# EasyEDA Pro project PRO_project.eprj, board PCB1 (continued)
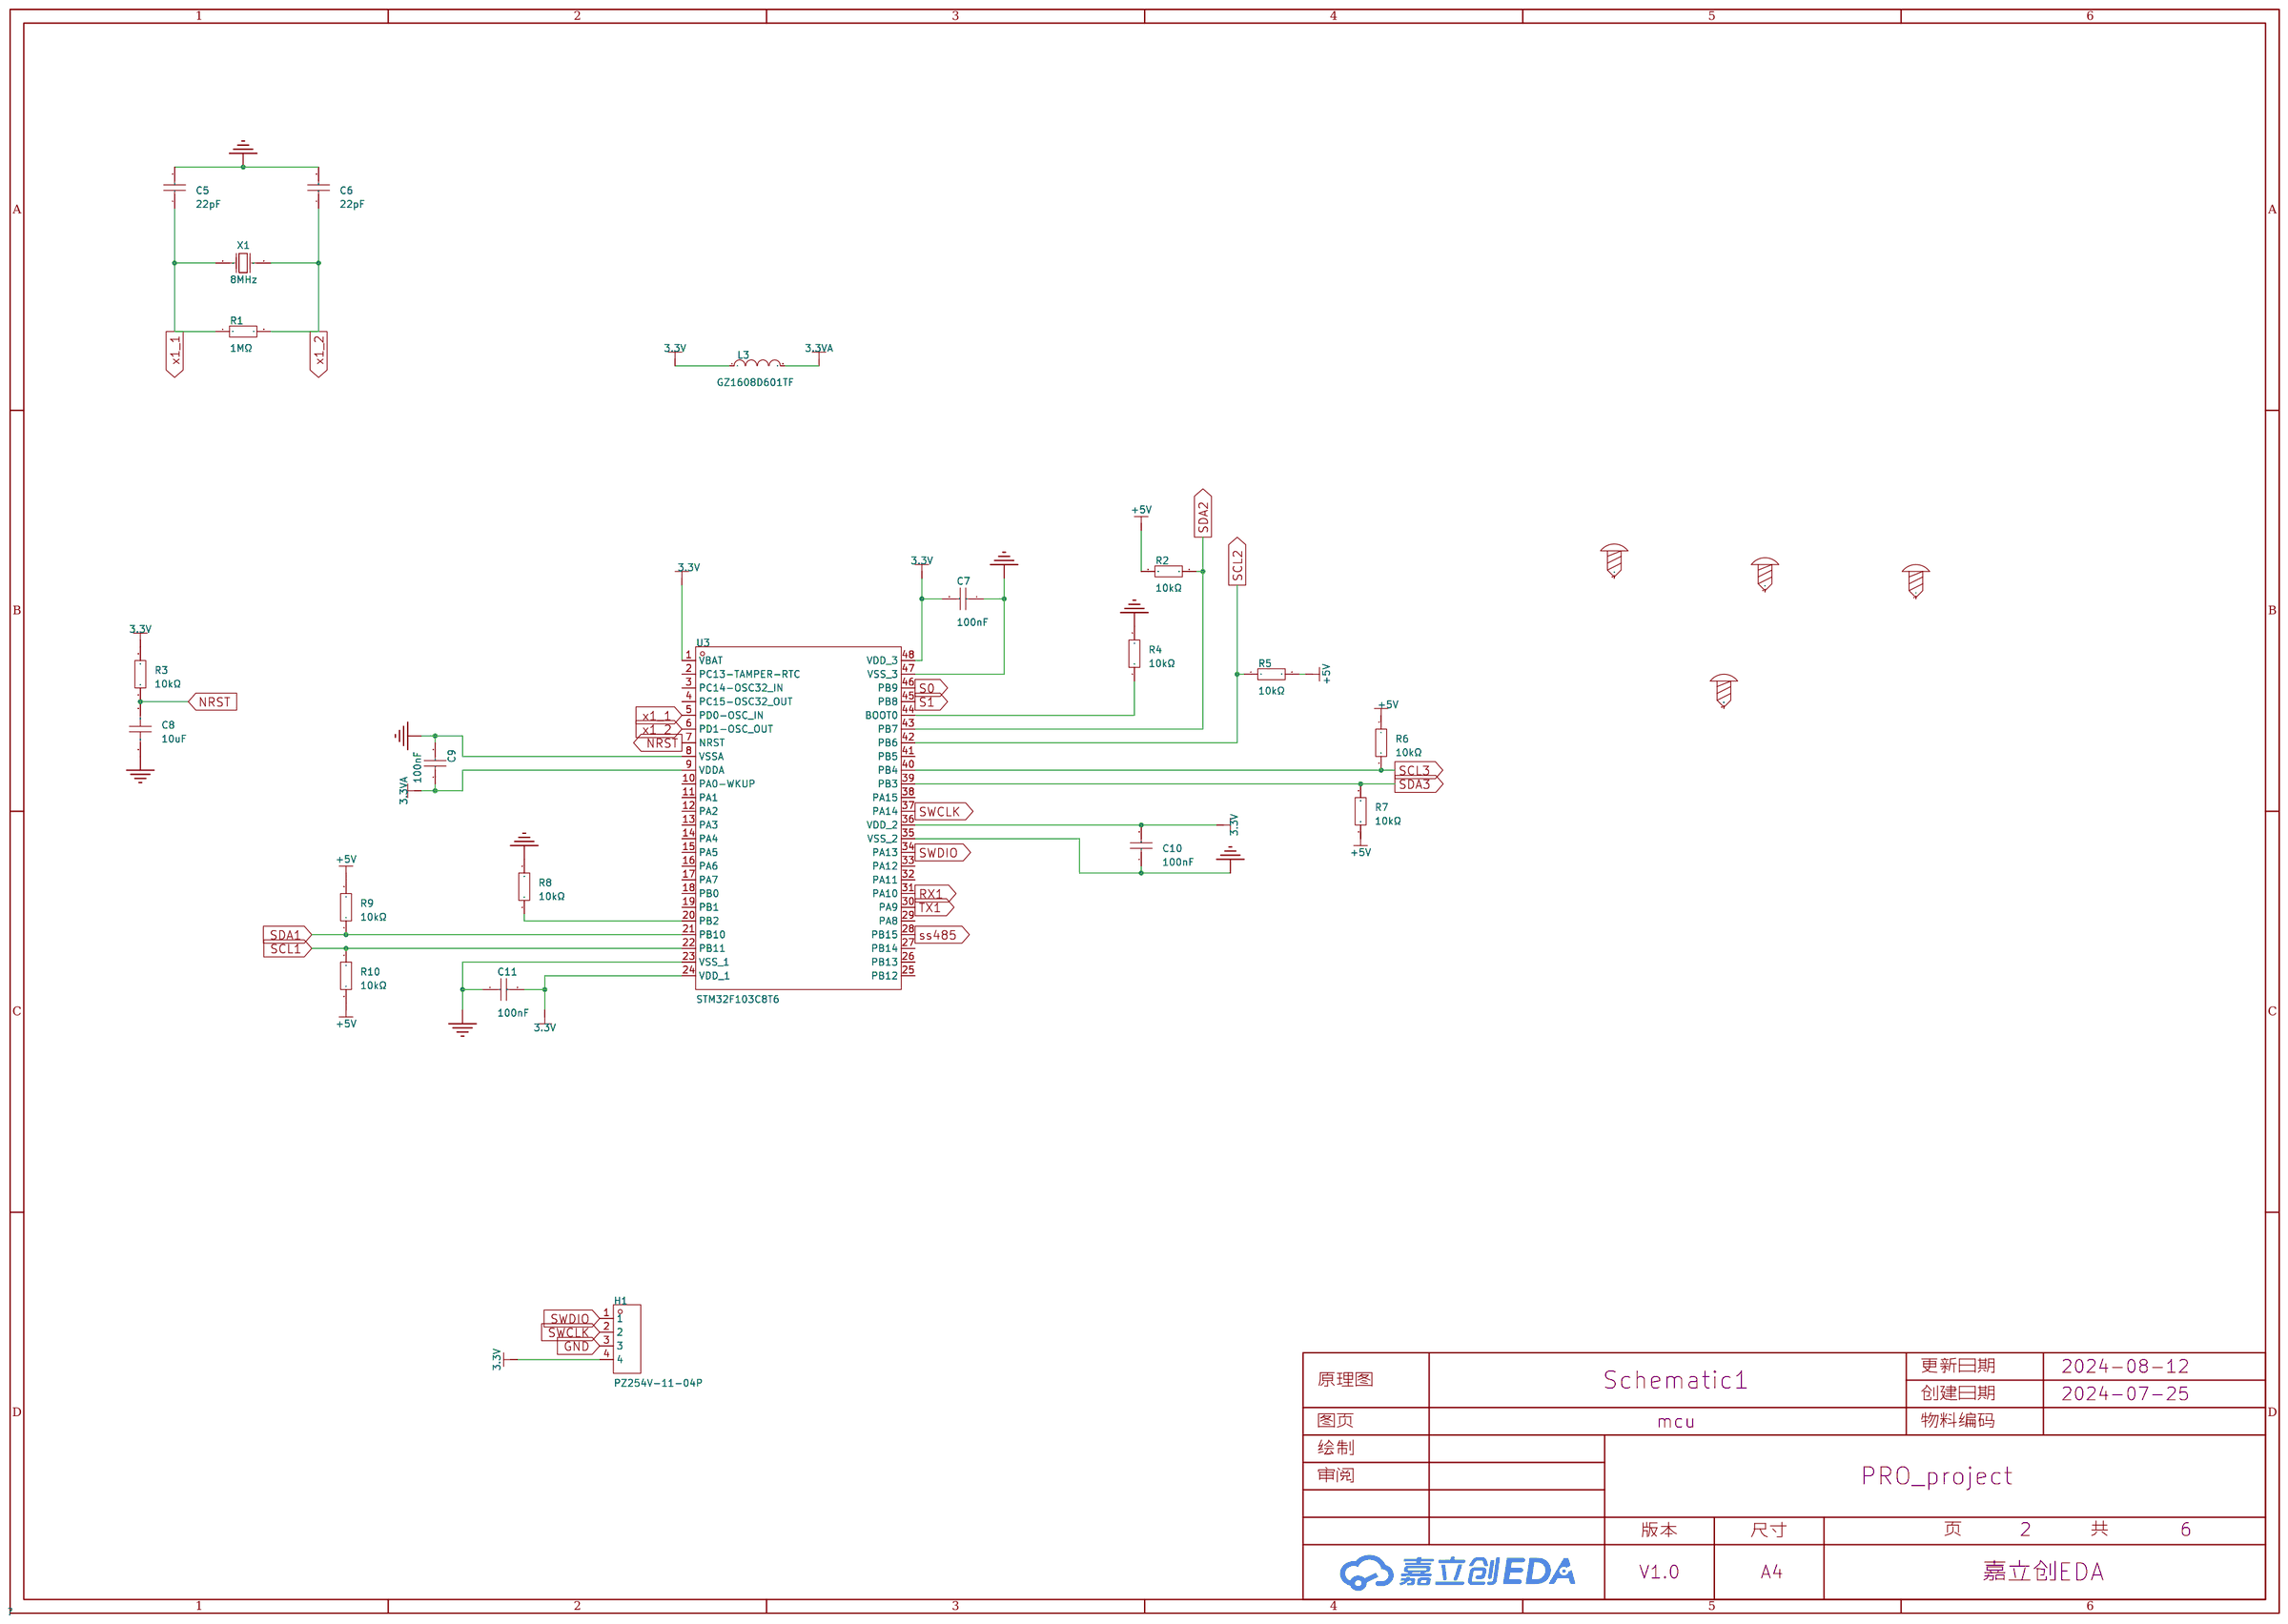
[diagram p0: mcu]
## Routing (per net, layer and track width the routed paths; a pad name or vN(x,y) marks a point on that pad's centre or on a via; arc(x,y) is an arc through that point) (continued)
  Top Layer w0.762: 29.47,27.43 34.4,27.43 U2.3 ; 29.47,27.43 L2.2 29.47,21.49 27.83,19.85 27.83,14.34 28.39,13.78 36.6,13.78 U36.2 ; 29.47,27.43 29.47,31.14 28.84,31.77 C3.1 27.2,33.87 25.42,35.65 15.18,35.65 U1.4 ; C20.2 3.9,52.94 v1(3.86,52.98) ; C49.1 34.82,46.91 v1(34.64,47.09)
  Bottom Layer w0.254: v1(36.18,35.29) 30.72,35.29 C3.1 ; v1(115.49,42.32) 115.52,42.32 ; v1(38.15,43.44) 34.64,46.95 34.64,46.99 v1(32.69,45.04) 32.69,45.14 ; v1(97.93,49.22) 97.93,50.07 97.9,50.1 ; v1(103.03,41.7) 103.03,50.25 102.99,50.29 ; v1(71.06,51.47) 71.04,51.49 69.59,51.49 69.06,50.96 69.06,50.03 v1(69.16,49.93) 69.1,49.93 ; v1(85.35,49.67) 85.97,50.29 89.95,50.29 ; 102.99,50.29 115.29,50.29 v1(115.49,50.09) ; 102.99,50.29 89.95,50.29 ; v1(12.9,53.61) 14.17,52.34 14.17,47.03 14.1,47.03 v1(14.05,47.08) ; 89.95,50.29 90.11,50.13 v1(90.11,49.02) ; v1(39.33,50.83) 38.38,50.83 v1(34.64,47.09)
  Bottom Layer w0.508: v1(115.49,42.32) 115.49,47.38 v1(115.47,47.4)
  Bottom Layer w0.762: U27.2 116.17,27.6 U24.2 102.64,27.26 U25.2 75.52,27.26 U26.2 67.84,27.78 67.63,27.99 ; 2.17,52.98 2.17,41.76 2.94,41 13.61,41 16.96,37.65 16.96,28.85 19.68,26.13 25.13,26.13 27.2,28.2 C3.1 ; 2.17,52.98 v1(3.86,52.98) ; 2.17,52.98 2.14,53.01 2.14,57.71 3.18,58.75 U8.2 U10.2 U9.2 U11.2 U16.2 U17.2 U18.2 U19.2 ; U36.2 34.36,14.29 33.35,13.27 33.35,10.48 34.22,9.61 64.06,9.61 67.63,13.18 67.63,27.99 ; 67.63,27.99 v1(67.63,29.17)
GND: length 502.2
  Top Layer w0.254: U20.5 102.53,33.75 C44.1 ; C4.2 42.49,26.54 v1(43.84,27.89) ; 98.95,40.06 98.97,40.07 101.12,40.07 ; v1(42.67,45.93) 44.44,47.7 ; v1(42.67,45.93) 39.98,45.93 v1(38.99,46.91) C49.2 ; v1(42.67,45.93) 42.76,45.84 42.76,44.02 43.81,42.97 C9.2 ; 44.44,47.7 C8.1 ; 44.44,47.7 43.75,47.7 42.92,48.53 v1(42.87,48.53) ; 45.47,37.12 45.47,37.71 v1(44.74,38.44) ; U13.5 65.5,56.54 C32.1 61.95,52.88 v1(61.95,50.6) ; H1.3 62.27,32.33 62.09,32.52 ; U21.5 87.71,33.08 C46.1 ; C53.2 116.06,39.74 v1(115.37,39.06) ; U29.2 32.69,39.67 30.33,37.31 v1(27.2,37.31) ; U6.5 20.29,53.75 C22.1 ; v1(66.41,49.42) 67.21,48.62 C51.2 ; U30.6 U30.7 U30.8 79.36,42.1 v1(79.99,41.47) 81.01,40.45 83.87,40.45 85.08,41.66 U31.2 ; C47.1 115.78,33.14 U23.5 ; v1(54.25,42.05) 54.69,42.05 55.59,42.95 55.59,43.97 56.18,44.56 v1(57.26,44.56) 58.24,45.54 v1(58.24,47.21) 58.24,50.99 57.52,51.71 49.07,51.71 48.74,51.38 v1(48.74,48.88) 47.92,48.06 v1(47.92,46.4) 47.92,45.72 49.27,44.37 51.08,44.37 v1(51.58,43.87) ; U3.23 53.57,34.27 53.57,34.28 v1(54.81,34.28) 54.81,33.38 54.82,33.38 U3.35 ; C35.1 105.79,54 U15.5 ; 22.18,42.71 24.28,42.71 U28.8 ; v1(27.2,37.31) 26.28,37.31 23.13,40.46 U28.7 ; v1(27.2,37.31) 27.13,37.24 ; U22.5 74.46,33.65 C45.1 ; C23.1 46.4,51.96 45.2,50.76 v1(43.56,50.76) ; C21.1 35.31,55.86 U5.5 ; v1(106.1,48.39) 106.1,48.38 106.1,46.46 ; C7.1 v1(59.84,40.59) 60.92,40.59 R4.2 ; v1(48.03,43.59) 48.03,43.42 48.38,43.07 50.54,43.07 51.82,41.79 U3.8 51.82,39.35 52.4,38.77 56.81,38.77 U3.47 ; v1(6.99,50.34) 2.23,50.34 2.21,50.36 ; U33.2 101.07,47.14 v1(101.08,47.15) ; C48.2 11.27,49.45 v1(11.27,50.34) ; U32.8 106.1,46.46 ; 106.1,46.46 U32.6 ; v1(86.79,48.74) 86.34,48.28 C50.2
  Top Layer w0.508: U4.5 7.87,56.21 U8.1 ; U15.5 106.46,56.21 U19.1 ; U5.5 35.16,56.21 U9.1 ; U6.5 21.23,56.21 U10.1 ; U25.1 89.52,30.06 C46.1 ; U16.1 64.95,56.21 U13.5 ; U11.1 49.47,56.21 U7.5 ; U18.1 91.96,56.21 U14.5 ; U26.1 74.92,30.4 C45.1 ; 76.68,56.21 79.04,56.21 U12.5 ; U24.1 102.72,30.4 C44.1 ; C47.1 116.62,33.12 U27.1
  Top Layer w0.762: U2.1 32.5,31.91 27.17,37.24 U1.5 v1(8.15,37.24) U1.6 ; D2.1 13.39,10.98 8.71,10.98 4.84,14.85 C1.2 4.84,33.75 U1.6 ; D2.1 13.7,11.19 CN1.2 ; D2.1 15.36,11.24 16.34,12.22 D3.1 ; U8.1 3.25,56.21 2.21,55.17 2.21,36.38 U1.6 ; C33.1 77.77,53.41 77.77,55.12 76.68,56.21 U17.1 ; 53.17,50.29 53.42,50.54 v1(53.42,51.77) ; 53.17,50.29 54.55,50.29 C5.2 ; 53.17,50.29 C6.2 ; U1.6 v1(8.5,33.84) U1.3 ; U18.1 91.31,55.27 91.31,53.8 C34.1
  Bottom Layer w0.254: v1(11.27,50.34) v1(6.99,50.34) ; v1(43.56,50.76) 42.92,50.12 42.92,48.6 42.87,48.55 v1(42.87,48.53) 43.48,48.53 48.03,43.98 v1(48.03,43.59) ; v1(66.41,49.42) 66.39,49.44 ; v1(115.37,39.06) 115.37,39.07
  Bottom Layer w0.762: v1(120.11,33.49) 120.11,33.18 U27.1 116.17,30.14 U24.1 102.64,29.8 U25.1 88.74,30.32 U26.1 ; U8.1 U10.1 U9.1 U11.1 U16.1 ; U19.1 U18.1 U17.1 U16.1 ; U16.1 62.61,51.26 v1(61.95,50.6)
  vias: v1(1.18,29.01) v1(1.53,38.14) v1(7.95,29.01) v1(10.46,51.99) v1(32.44,49) v1(40.12,40.39) v1(42.95,30.48) v1(48.73,29.82) v1(50.45,25) v1(51.51,22.39) v1(56.75,11) v1(59.14,14.11) v1(59.34,18.6) v1(60.96,10.8) v1(65.12,12.38) v1(78.68,33.93) v1(90.15,37.54) v1(98.96,40.08) v1(111.18,43.17) v1(113.64,52.24) v1(116.98,45.17) v1(117.06,47.2) v1(117.06,36) v1(118.09,52.24) v1(120.16,36.64) v1(120.56,44.5)
1N0: length 35.3
  Top Layer w0.254: v1(36.56,53.86) 36.63,53.86 36.78,54 36.78,55.86 ; v1(15.4,44.47) 15.51,44.36 15.51,42.59
  Bottom Layer w0.254: v1(15.4,44.47) 15.35,44.47 15.35,53.93 15.92,54.5 35.92,54.5 v1(36.56,53.86)
1N1: length 25.5
  Top Layer w0.254: 20.59,42.59 20.62,42.56 20.62,39.98 v1(20.64,39.98) ; v1(23.35,53.51) 23.35,55.35 U6.6
  Bottom Layer w0.254: v1(20.64,39.98) 19.98,39.32 18.91,39.32 17.82,40.41 17.82,51.37 19.47,53.02 22.86,53.02 v1(23.35,53.51)
1N2: length 18.3
  Top Layer w0.254: 9.2,56.15 9.2,49.75 13.31,45.64 15.98,45.64 16.78,44.84 U28.2
1N3: length 46.6
  Top Layer w0.254: U28.4 19.32,40.59 v1(19.29,40.57) ; v1(49.15,53.56) 50.96,55.36 U7.6
  Bottom Layer w0.254: v1(19.29,40.57) 19.29,51 19.98,51.69 47.28,51.69 v1(49.15,53.56)
1P0: length 23.6
  Top Layer w0.254: 20.59,48.06 20.59,49.98 21.6,51 36.22,51 38.07,52.85 38.07,55.83 U5.7
1P1: length 13.1
  Top Layer w0.254: U28.14 18.05,50.45 19.34,51.75 24.35,51.75 24.6,52 24.6,55.37 U6.7
1P2: length 11.8
  Top Layer w0.254: U28.15 16.78,49.59 16.24,50.13 14.31,50.13 10.47,53.97 U4.7
1P3: length 34.7
  Top Layer w0.254: U28.11 21.86,49.56 22.18,49.89 46.48,49.89 52.23,55.63 U7.7
1ZN: length 17.5
  Top Layer w0.254: U28.3 18.05,44 18.36,44.32 28.98,44.32 29.73,43.57 29.73,42.07 30.81,40.99 U29.1
1ZP: length 16
  Top Layer w0.254: U28.13 19.32,46.04 19.97,45.39 31,45.39 31.74,44.65 U29.6
2N0: length 40
  Top Layer w0.254: v1(67.9,43.03) 68.83,42.1 U30.1 ; U14.6 94.67,54.76 94.67,52.98 94.19,52.5 v1(93.54,52.5)
  Bottom Layer w0.254: v1(93.54,52.5) 68.7,52.5 67.9,51.7 v1(67.9,43.03)
2N1: length 43.5
  Top Layer w0.254: U12.6 80.77,54.16 v1(80.64,54.04) ; U30.5 74.59,39.49 v1(74.62,39.46)
  Bottom Layer w0.254: v1(80.64,54.04) 65.14,54.04 64.02,52.92 64.02,43.61 68.57,39.06 74.22,39.06 v1(74.62,39.46)
2N2: length 19.6
  Top Layer w0.254: U30.2 70.7,42.18 70.7,44.29 69.44,45.55 66.15,45.55 65.1,46.6 65.1,50.78 66.77,52.44 U13.6
2N3: length 50.2
  Top Layer w0.254: v1(108.43,53.01) 108.38,53.06 108.38,55.32 U15.6 ; v1(73.27,40.29) 73.32,40.33 U30.4
  Bottom Layer w0.254: v1(73.27,40.29) 73.27,49.66 75.29,51.67 107.1,51.67 v1(108.43,53.01)
2P0: length 27.4
  Top Layer w0.254: U14.7 95.67,54.88 95.67,51.53 95.1,50.96 75.9,50.96 74.59,49.64 U30.12
2P1: length 16.5
  Top Layer w0.254: 82.04,55.75 82.04,53.36 80.31,51.64 73.21,51.64 72.05,50.47 U30.14
2P2: length 10.3
  Top Layer w0.254: 68.04,56.75 68.04,52.92 70.78,50.18 U30.15
2P3: length 40.8
  Top Layer w0.254: U30.11 75.86,49.48 76.73,50.36 109.04,50.36 109.74,51.06 109.74,55.41 U15.7
2ZN: length 14.4
  Top Layer w0.254: U31.1 84.09,42.58 84.09,43.21 83.54,43.76 72.49,43.76 72.05,43.31 U30.3
2ZP: length 13.1
  Top Layer w0.254: U31.6 83.55,44.66 74.81,44.66 73.32,46.15 U30.13
3N0: length 42.4
  Top Layer w0.254: U32.1 113.72,45.2 v1(114.2,44.72) ; v1(86.06,33.8) 85.42,33.8 84.73,33.1 U21.6
  Bottom Layer w0.254: v1(114.2,44.72) 114.2,37.16 111.18,34.14 87.21,34.14 86.87,33.8 v1(86.06,33.8)
3N1: length 26.9
  Top Layer w0.254: v1(108.62,48.64) 108.64,48.62 U32.5 ; v1(99.8,35.33) 99.8,34.44 98.72,33.36 98.75,33.36 98.75,31.27 U20.6
  Bottom Layer w0.254: v1(99.8,35.33) 100.99,36.52 106.54,36.52 108.59,38.57 108.59,48.61 v1(108.62,48.64)
3N2: length 21.7
  Top Layer w0.254: U32.2 112.45,44.11 112.7,43.86 116.67,43.86 117.3,43.23 117.3,38.65 112.44,33.78 U23.6
3N3: length 74
  Top Layer w0.254: v1(109.88,48.84) 109.91,48.81 U32.4 ; v1(70.89,32.72) 70.89,31.35 U22.6
  Bottom Layer w0.254: v1(70.89,32.72) 115.14,32.72 118.49,36.07 118.49,48.04 117.29,49.24 110.28,49.24 v1(109.88,48.84)
3P0: length 32.3
  Top Layer w0.254: U21.7 83.46,34.05 84.08,34.67 93.73,34.67 95.65,36.59 106.85,36.59 108.64,38.37 U32.12
3P1: length 21.9
  Top Layer w0.254: U32.14 111.18,37.95 109.14,35.91 98.01,35.91 97.5,35.4 U20.7
3P2: length 10.5
  Top Layer w0.254: U23.7 111.17,35.23 112.54,36.61 112.54,40.9 U32.15
3P3: length 45
  Top Layer w0.254: U22.7 69.58,34.05 70.76,35.24 93.23,35.24 95.33,37.34 106.36,37.34 107.37,38.34 U32.11
3ZN: length 11.4
  Top Layer w0.254: U32.3 111.18,44.75 110.95,44.53 103.07,44.53 U33.1
3ZP: length 9.7
  Top Layer w0.254: U33.6 109.63,42.88 109.97,42.54 109.97,41.06 U32.13
485+: length 46.9
  Top Layer w0.254: v1(50.14,18.13) 54.03,18.13 U37.4
  Top Layer w0.381: v1(40.4,12.8) 39.53,13.67 R61.1 39.53,15.57 41.02,17.05 42.2,17.05
  Top Layer w0.762: C55.2 30.74,19.12 31.4,19.78 35.45,19.78 ; 35.45,19.78 35.45,23.08 R67.2 35.44,23.12 R63.2 ; 35.45,19.78 36.7,19.78 U36.4
  Bottom Layer w0.254: v1(50.14,18.13) 49.34,17.33 49.34,13.84 48.3,12.8 v1(40.4,12.8)
  Bottom Layer w0.381: v1(40.4,12.8) 41.49,13.89 41.49,17.05 38.8,19.74 37.48,19.74 U36.4
485-: length 51.1
  Top Layer w0.381: U35.3 45.21,27.51 v1(44.36,26.66) ; v1(50.58,12.58) 50.58,14.27 50.43,14.42 ; U36.3 39.21,16.83 39.58,17.2 39.58,20.22 40.29,20.93 42.13,20.93 42.2,20.86 44.24,20.86 v1(44.32,20.95) 44.29,20.98 44.29,22.8 R65.1
  Top Layer w0.762: U36.3 36.49,16.21 31.66,16.21 30.74,17.13 C55.1
  Bottom Layer w0.381: v1(50.58,12.58) 50.56,12.56 50.56,11.95 49.82,11.21 39.59,11.21 39.28,11.52 39.28,16.37 38.82,16.83 U36.3 ; v1(44.36,26.66) 44.36,20.99 v1(44.32,20.95)
DI: length 15.1
  Top Layer w0.381: U34.4 47.79,21.05 U35.4
  Top Layer w0.762: U35.4 47.66,24.84 R63.1
NRST: length 10.6
  Top Layer w0.254: U3.7 52.32,42 50.75,43.57 49.31,43.57 46.83,46.05 R3.1 46.68,46.32 C8.2
RO: length 9.9
  Top Layer w0.254: U34.1 50.63,17.05 52.07,15.61 52.07,13.08 52.48,12.67 U38.2
RX1: length 34.3
  Top Layer w0.254: 65.45,25.9 65.74,25.61 65.74,15.74 65.05,15.05 63.25,15.05 U38.4 ; 65.45,25.9 v1(65.35,25.9) ; 65.45,25.9 64.74,26.61 R66.2 ; v1(53.81,29.17) 52.82,30.16 U3.31
  Bottom Layer w0.254: v1(65.35,25.9) 64.38,24.93 54.82,24.93 53.81,25.94 v1(53.81,29.17)
S0: length 110.1
  Top Layer w0.254: v1(77.1,45.82) 77.1,47.55 U30.10 ; U28.10 23.13,46.72 23.61,46.24 33.99,46.24 34.7,45.53 39.12,45.53 43.6,41.05 v1(46.46,41.05) ; v1(91.75,38.74) 91.75,38.7 92.32,38.13 105.39,38.13 106.1,38.83 106.1,40.99 ; v1(50.98,38.59) 51.3,38.27 U3.46 57.86,38.27 v1(58.58,38.99)
  Bottom Layer w0.254: v1(91.75,38.74) 91.73,38.76 91.73,45.97 90.32,47.38 78.66,47.38 v1(77.1,45.82) 77.1,38.07 76.04,37.01 67.82,37.01 65.84,38.99 v1(58.58,38.99) ; v1(50.98,38.59) 48.52,41.05 v1(46.46,41.05)
S1: length 101.2
  Top Layer w0.254: v1(40.46,47.33) 39.73,48.06 U28.9 ; v1(78.46,45.64) 78.4,45.7 U30.9 ; v1(59.12,38.15) 58.74,37.77 U3.45 v1(50.39,37.77) ; U32.9 104.83,39.64 104.57,39.39 95.58,39.39 v1(95.45,39.26)
  Bottom Layer w0.254: v1(78.46,45.64) 78.46,38.4 76.57,36.51 ; 76.57,36.51 92.7,36.51 v1(95.45,39.26) ; 76.57,36.51 67.47,36.51 65.83,38.15 v1(59.12,38.15) ; v1(50.39,37.77) 48.11,37.77 45.05,40.83 45.05,41.87 40.46,46.46 v1(40.46,47.33)
SCL1: length 18.7
  Top Layer w0.254: U3.22 42.87,34.77 40.11,37.53 38.96,37.53 38.94,37.51 38.9,37.47 34.78,37.47 33.64,38.61 U29.3
SCL2: length 39.8
  Top Layer w0.254: R5.1 88.54,42.63 v1(88.54,41.23) 88.54,40.49 87.14,39.09 78.4,39.09 77.13,37.82 64.66,37.82 63.11,36.27 U3.42 ; U31.3 86.07,42.5 86.02,42.45 v1(86.02,41.05)
  Bottom Layer w0.254: v1(86.02,41.05) 88.36,41.05 v1(88.54,41.23)
SCL3: length 47.7
  Top Layer w0.254: U33.3 99.94,45.76 R6.2 95.19,45.76 87.83,38.4 80.29,38.4 79.04,37.15 68.01,37.15 66.13,35.27 U3.40
SDA1: length 21.7
  Top Layer w0.254: U29.4 35.37,43.69 35.67,43.39 35.67,39.94 36.38,39.23 38.74,39.23 R9.1 41.57,39.36 42.43,38.5 42.43,36.14 43.3,35.27 U3.21
SDA2: length 39.5
  Top Layer w0.254: U31.4 87.38,45.24 ; 87.38,45.24 88.52,45.24 R2.2 ; 87.38,45.24 87.44,45.18 87.44,40.69 86.42,39.67 78.03,39.67 76.69,38.33 64.42,38.33 62.86,36.77 U3.43
SDA3: length 46.7
  Top Layer w0.254: U3.39 66.87,34.77 68.74,36.64 79.9,36.64 81.08,37.82 88.54,37.82 93.61,42.89 100.11,42.89 U33.4
SS: length 13
  Top Layer w0.381: U34.3 U34.2 ; U34.3 47.55,19.54 46.37,19.54 45.96,19.95 R65.2 ; U34.3 50.26,19.59 51.28,20.62 54.08,20.62 U37.3
SS485: length 20.2
  Top Layer w0.254: U37.2 59.4,20.61 57.25,22.76 54.46,22.76 51.32,25.9 U3.28
SWCLK: length 5.6
  Top Layer w0.254: H1.2 59.75,30.36 59.75,32.51 58.49,33.77 U3.37
SWDIO: length 4.6
  Top Layer w0.254: U3.34 54.32,30.77 54.84,30.25 57.01,30.25 57.14,30.12
TX1: length 8.5
  Top Layer w0.254: U35.2 56.61,27.43 53.59,27.43 52.32,28.7 U3.30
X1_1: length 10.9
  Top Layer w0.254: 56.51,50.39 56.51,47.44 X1.2 54.39,45.32 R1.1 53.32,42.16 U3.5
X1_2: length 10.5
  Top Layer w0.254: 49.9,50.04 49.9,47.13 X1.1 52.89,44.15 R1.2 52.82,43.17 U3.6
$1N1353: length 7.9
  Top Layer w0.254: U3.44 61.06,37.27 61.79,38 R4.1
$1N9152: length 3.3
  Top Layer w0.254: R8.2 45.47,35.85 45.55,35.77 U3.20
$2N657: length 14.3
  Top Layer w0.762: U1.2 17.54,32.14 19.14,30.54 19.14,26.83 19.09,26.78 19.21,26.66 ; D3.2 16.81,26.66 19.21,26.66 ; 19.21,26.66 L1.2
$2N1653: length 14.3
  Top Layer w0.762: C2.1 24.24,15.5 22.25,15.5 21.75,16 L1.1 25.86,20.06 26.87,21.07 L2.1
$2N2288: length 10.9
  Top Layer w0.762: D1.2 18.91,11.31 D2.2 18.83,4.19 CN1.1
$2N2289: length 21.7
  Top Layer w0.762: U1.1 12.97,30.44 12.47,29.94 12.47,20.41 11.7,19.64 C1.1 9.84,18.77 D1.1
$3N444: length 5.4
  Top Layer w0.762: R22.1 40.15,71.19 R21.1
$3N877: length 14.7
  Top Layer w0.254: U9.3 32.79,61.3 31.26,61.3 30.76,61.8 30.76,68.08 31.02,68.34 C17.1 35.06,68.34 35.45,67.95 35.45,66.81 U5.4
$3N883: length 11.9
  Top Layer w0.254: U5.1 39.32,65.39 39.04,65.12 34.09,65.12 U9.4 32.18,64.45 C17.2
$3N1473: length 7
  Top Layer w0.762: R15.2 22.95,81.72 CN4.1
$3N1476: length 6.7
  Top Layer w0.762: CN4.2 28.35,82.12 R16.2
$3N1479: length 5.5
  Top Layer w0.762: R23.1 28.15,71.03 R24.1
$3N1489: length 16.8
  Top Layer w0.254: R15.1 20.49,74.73 20.05,74.29 20.05,70.75 21.63,69.17 22.64,69.17 23.26,68.55 U6.3
  Top Layer w0.762: R15.1 22.95,74.07 ; 22.95,74.07 R23.2 ; 22.95,74.07 23,74.03 C14.1
$3N1497: length 17.9
  Top Layer w0.254: U6.2 24.53,68.63 24.74,68.85 29.05,68.85 30.27,70.07 30.27,73.58 29.82,74.03 28.35,74.03
  Top Layer w0.762: 28.35,74.07 R24.2 ; 28.35,74.07 28.31,74.03 C14.2 ; 28.35,74.07 R16.1
$3N1505: length 15.7
  Top Layer w0.254: U6.4 22.02,66.38 22.02,67.26 20.91,68.37 C18.1 16.72,68.37 16.2,67.85 16.2,63.26 18.05,61.41 18.98,61.41 U10.3
$3N1512: length 12.5
  Top Layer w0.254: U6.1 25.8,65.31 25.23,64.75 21.01,64.75 20.09,63.83 U10.4 18.4,63.83 17.78,64.45 17.78,66.83 C18.2
$3N1940: length 8.9
  Top Layer w0.762: CN2.1 7.76,77 R11.2
$3N1943: length 8.7
  Top Layer w0.762: CN2.2 18.83,82.24 R12.2
$3N1946: length 5.6
  Top Layer w0.762: R19.1 R20.1
$3N1956: length 14.7
  Top Layer w0.254: 7.76,73.77 6.64,73.77 5.76,72.89 5.76,69.72 6.53,68.95 8.6,68.95 9.2,68.35 9.2,67.05
  Top Layer w0.762: 7.76,73.77 R19.2 ; 7.76,73.77 9.76,73.77 C12.1 ; 7.76,73.77 R11.1
$3N1964: length 15.3
  Top Layer w0.254: U4.2 10.47,68.01 11.44,68.99 14.36,68.99 14.96,69.59 14.96,73.06 14.81,73.21 13.82,73.21 13.36,73.67
  Top Layer w0.762: 13.36,73.67 13.36,74.57 R12.1 ; 13.36,73.67 R20.2 ; 13.36,73.67 13.36,73.67 C12.2
$3N1972: length 13.8
  Top Layer w0.254: U8.3 2.4,64.35 2.4,67.54 3.1,68.24 C16.1 5.54,68.24 6.5,67.28 7.7,67.28 U4.4
$3N1979: length 12.5
  Top Layer w0.254: C16.2 4.11,65.18 U8.4 5.46,64.67 6.21,65.42 11.51,65.42 11.74,65.64 U4.1
$3N2407: length 8.5
  Top Layer w0.762: CN5.1 45.56,78.92 47.24,77.24 48.6,77.24 R17.2
$3N2410: length 8.1
  Top Layer w0.762: R18.2 54.55,79.3 CN5.2
$3N2413: length 5.7
  Top Layer w0.762: R25.1 R26.1
$3N2423: length 14.9
  Top Layer w0.254: U7.3 50.96,68.17 49.81,69.32 47.67,69.32 47,69.99 47,73 47.19,73.19 R25.2
  Top Layer w0.762: 48.85,74.01 R25.2 ; 48.85,74.01 50.73,74.01 C15.1 ; 48.85,74.01 R17.1
$3N2431: length 16
  Top Layer w0.254: U7.2 52.23,68.56 52.55,68.89 55.86,68.89 56.26,69.29 56.26,73.31 55.63,73.94 54.55,73.94
  Top Layer w0.762: 54.55,73.94 54.4,73.79 C15.2 ; 54.55,73.94 R18.1 ; 54.55,73.94 R26.2
$3N11930: length 7.2
  Top Layer w0.762: R33.2 105.34,81.02 CN6.1
$3N11931: length 5.3
  Top Layer w0.762: R39.1 96.54,71.04 R40.1
$3N11934: length 17.4
  Top Layer w0.254: U14.3 94.48,68.27 92.99,69.76 90.16,69.76 89.05,70.87 89.05,72.7 89.92,73.57 90.81,73.57 R39.2
  Top Layer w0.762: 91.34,73.96 91.34,74.74 R31.1 ; 91.34,73.96 R39.2 ; 91.34,73.96 93.12,73.96 C26.1
$3N11935: length 17.6
  Top Layer w0.254: R32.1 97.11,74.47 98.58,74.47 99.41,73.64 99.41,70.46 98.34,69.39 96.49,69.39 95.75,68.64 U14.2
  Top Layer w0.762: C26.2 96.46,73.84 96.64,74.02 ; 96.64,74.02 R40.2 ; 96.64,74.02 R32.1
$3N11945: length 12.1
  Top Layer w0.762: CN9.1 66.66,83.11 64.47,80.92 64.47,77.17 R29.2
$3N11946: length 5.3
  Top Layer w0.762: R36.1 82.94,71.24 R35.1
$3N11949: length 17.6
  Top Layer w0.254: R35.2 77.41,73.77 75.61,73.77 75.35,73.51 75.35,70.53 75.99,69.89 79.12,69.89 80.77,68.24 U12.3
  Top Layer w0.762: 77.94,73.93 R35.2 ; 77.94,73.93 R27.1 ; 77.94,73.93 79.75,73.93 C24.1
$3N11950: length 14.8
  Top Layer w0.254: 83.14,73.84 84.27,73.84 85.34,72.77 85.34,69.89 84.51,69.06 82.84,69.06 82.04,68.25 82.04,66.65
  Top Layer w0.762: 83.14,73.9 R36.2 ; 83.14,73.9 R28.1 ; 83.14,73.9 83.08,73.84 C24.2
$3N11960: length 8.3
  Top Layer w0.762: R27.2 78.78,77.04 82.21,80.47 CN7.1
$3N11961: length 5.4
  Top Layer w0.762: R38.1 69.74,71.14 R37.1
$3N11964: length 15.7
  Top Layer w0.254: U13.3 66.77,68.91 66.2,69.48 63.33,69.48 62.02,70.79 62.02,72.83 63.26,74.06 64.44,74.06
  Top Layer w0.762: R29.1 64.44,74.94 64.44,74.06 ; C25.1 64.77,73.74 64.44,74.06 ; 64.44,74.06 R37.2
$3N11965: length 15.9
  Top Layer w0.254: 68.04,67.65 68.04,69.21 68.47,69.65 71.52,69.65 72.18,70.31 72.18,73.36 71.48,74.06 69.84,74.06
  Top Layer w0.762: R30.1 R38.2 69.34,73.74 C25.2
$3N11974: length 5.8
  Top Layer w0.762: R41.1 111.05,71.14 R42.1
$3N11977: length 17.2
  Top Layer w0.254: 105.34,73.94 103.63,73.94 103.16,73.47 103.16,70.24 103.65,69.75 106.54,69.75 108.5,67.79 U15.3
  Top Layer w0.762: 105.34,74.02 R41.2 ; 105.34,74.02 105.42,73.94 C27.1 ; 105.34,74.02 R33.1
$3N11978: length 17.1
  Top Layer w0.254: U15.2 109.77,68.84 109.91,68.99 112.64,68.99 113.5,69.85 113.5,73.74 113.35,73.89 111.11,73.89
  Top Layer w0.762: C27.2 111.06,73.94 111.11,73.89 ; 111.11,73.89 R42.2 ; 111.11,73.89 111.11,74.77 R34.1
$3N13638: length 6.7
  Top Layer w0.762: R45.2 87.1,4.14 87.29,3.95
$3N13639: length 5.4
  Top Layer w0.762: R54.1 86.8,16.1 R53.1
$3N13642: length 16.2
  Top Layer w0.254: U21.3 84.76,20.43 84.76,18.74 85.56,17.94 88.68,17.94 89.18,17.44 89.18,13.83 88.87,13.52 87.1,13.52
  Top Layer w0.762: C37.1 87.08,13.5 87.1,13.52 ; R45.1 87.1,13.52 ; 87.1,13.52 R53.2
$3N13643: length 15
  Top Layer w0.254: 82.44,13.31 82.19,13.06 80.23,13.06 79.77,13.52 79.77,16.79 80.99,18.01 82.02,18.01 83.46,19.44 U21.2
  Top Layer w0.762: C37.2 83.61,13.31 82.44,13.31 ; 81.8,13.06 R46.1 ; R54.2 81.8,13.31
$3N13644: length 17.6
  Top Layer w0.254: U21.4 87.6,18.87 89.02,18.87 90.23,17.66 90.23,17.65 C41.1 92.71,17.65 93.04,17.98 93.04,22.46 90.78,24.72 U25.3
$3N13645: length 13.7
  Top Layer w0.254: C41.2 91.47,21.83 91.12,22.18 U25.4 89.17,22.09 82.53,22.09 82.19,21.74 U21.1
$3N13653: length 7.2
  Top Layer w0.762: R43.2 97.84,7.95 CN10.1
$3N13654: length 5.3
  Top Layer w0.762: R51.1 R52.1
$3N13657: length 15
  Top Layer w0.254: U20.3 98.77,20.35 98.77,18.57 99.47,17.87 101.66,17.87 102.03,17.5 102.03,14.12 101.58,13.67 99.99,13.67
  Top Layer w0.762: 100.16,13.5 100.16,12.27 R43.1 ; 100.16,13.5 R51.2 ; 100.16,13.5 99.99,13.67 C36.1
$3N13658: length 15.5
  Top Layer w0.254: U20.2 97.5,18.54 97.09,18.14 94.42,18.14 93.13,16.85 93.13,14.32 93.68,13.77 94.56,13.77 R52.2
  Top Layer w0.762: R44.1 R52.2 96.46,14.07 C36.2
$3N13659: length 15.3
  Top Layer w0.254: U24.3 103.85,25.06 105.96,22.95 105.96,18.65 105.3,17.99 C40.1 103.02,17.99 100.65,20.36 U20.4
$3N13660: length 12
  Top Layer w0.254: C40.2 104.32,21.18 U24.4 102.36,21.9 96.65,21.9 96.23,21.47 U20.1
$3N13668: length 11
  Top Layer w0.762: CN11.1 111.8,3.91 113.67,5.78 113.67,10.48 R49.2
$3N13669: length 5.2
  Top Layer w0.762: R58.1 113.7,16.24 R57.1
$3N13672: length 13.6
  Top Layer w0.254: U23.3 112.44,18.75 112.69,18.5 113.96,18.5 115.51,16.95 115.51,14.38 114.63,13.5 113.71,13.5
  Top Layer w0.762: R49.1 113.71,12.56 113.71,13.5 ; 113.71,13.5 113.57,13.64 C39.1 ; 113.71,13.5 R57.2
$3N13673: length 15.3
  Top Layer w0.254: 108.53,13.66 107.5,13.66 106.45,14.71 106.45,16.98 107.37,17.9 110.15,17.9 111.17,18.91 U23.2
  Top Layer w0.762: C39.2 110.41,13.66 108.53,13.66 ; R58.2 108.53,13.66 ; 108.53,13.66 R50.1
$3N13674: length 16.2
  Top Layer w0.254: U27.3 120.33,20.9 120.33,17.88 119.95,17.5 C43.1 116.38,17.5 U23.4
$3N13675: length 12
  Top Layer w0.254: U23.1 109.9,21.14 110.31,21.56 116.11,21.56 U27.4 118.44,20.25 C43.2
$3N13681: length 6.8
  Top Layer w0.762: R47.2 75.17,5.51 CN13.1
$3N13682: length 5.4
  Top Layer w0.762: R56.1 74.88,16.01 R55.1
$3N13685: length 17.6
  Top Layer w0.254: 75.07,12.97 76.22,12.97 76.71,13.46 76.71,16.72 75.36,18.07 71.1,18.07 70.85,18.32 U22.3
  Top Layer w0.762: R47.1 75.07,12.12 R55.2 74.75,13.51 C38.1
$3N13686: length 13.1
  Top Layer w0.254: U22.2 69.58,18.53 69.02,17.98 68.29,17.98 67.75,17.44 67.75,14.85 68.59,14.01 R56.2
  Top Layer w0.762: C38.2 71.24,14.01 R56.2 69.74,12.3 R48.1
$3N13687: length 17.7
  Top Layer w0.254: U26.3 76.5,25.24 79.39,22.35 79.39,18.83 78.74,18.18 C42.1 77.69,18.07 76.82,18.07 75.92,18.97 73.56,18.97 U22.4
$3N13688: length 13.2
  Top Layer w0.254: C42.2 77.8,21.14 76.45,22.49 75.21,22.49 U26.4 74.05,21.75 68.71,21.75 68.31,21.34 U22.1
$3N18144: length 17.6
  Top Layer w0.254: U14.4 93.21,67.34 92.05,68.5 C30.1 87.56,68.5 87.08,68.02 87.08,62.5 88.29,61.29 U18.3
$3N18145: length 12.6
  Top Layer w0.254: U14.1 97.02,64.5 96.34,63.83 U18.4 90.29,63.91 89.55,63.91 88.85,64.61 C30.2
$3N18189: length 15.8
  Top Layer w0.254: U12.4 79.5,67.71 78.63,68.58 C28.1 74.77,68.58 73.74,67.55 73.74,62.87 75.32,61.29 U17.3
$3N18190: length 12.1
  Top Layer w0.254: C28.2 75.73,64.67 U17.4 77.54,63.83 78.79,65.08 82.63,65.08 83.31,65.75 U12.1
$3N18234: length 15.5
  Top Layer w0.254: U13.4 64.67,68.47 C29.1 60.01,68.47 59.75,68.22 59.75,62.18 60.64,61.29 U16.3
$3N18235: length 14.1
  Top Layer w0.254: U13.1 69.31,66.49 69.05,66.24 64.05,66.24 62.61,64.8 U16.4 61.44,63.83 61.15,64.12 C29.2
$3N18279: length 16.8
  Top Layer w0.254: U15.4 106.24,66.34 104.08,68.5 C31.1 101.32,68.5 100.76,67.94 100.76,62.93 102.4,61.29 U19.3
$3N18280: length 13.3
  Top Layer w0.254: C31.2 102.33,64.66 103.16,63.83 U19.4 105.39,63.83 106.3,64.74 110.71,64.74 111.07,65.1 111.07,66.3 U15.1
$3N18687: length 15.6
  Top Layer w0.254: U11.3 45.57,61.29 44.31,62.55 44.31,68.15 44.52,68.36 C19.1 49.37,68.36 49.68,68.05 49.68,66.89 U7.4
$3N18688: length 12.7
  Top Layer w0.254: C19.2 45.7,64.15 46.02,63.83 U11.4 47.32,63.83 48.67,65.18 53.02,65.18 53.5,65.65 U7.1
$3N20010: length 16
  Top Layer w0.254: 36.78,66.76 36.78,68.72 36.28,69.22 34.15,69.22 32.51,70.86 32.51,73.23 33.42,74.14 34.85,74.14
  Top Layer w0.762: 34.85,74.14 R21.2 ; 34.85,74.14 36.7,74.14 C13.2 ; 34.85,74.14 R13.1
$3N20027: length 16.1
  Top Layer w0.254: 40.25,73.99 41.78,73.99 42.05,73.72 42.05,69.62 41.31,68.88 38.37,68.88 38.05,68.55 U5.2
  Top Layer w0.762: 40.25,73.87 40.13,73.99 C13.1 ; 40.25,73.87 R22.2 ; 40.25,73.87 R14.1
$3N20036: length 6.4
  Top Layer w0.762: CN3.1 34.85,83.09 R13.2
$3N20045: length 6.5
  Top Layer w0.762: R14.2 40.25,82.99 CN3.2
$3N20240: length 6.9
  Top Layer w0.762: R31.2 91.24,81.64 CN8.1
$3N20244: length 6.6
  Top Layer w0.762: R32.2 96.64,82.04 CN8.2
$3N20274: length 9.3
  Top Layer w0.762: R28.2 85.47,76.84 87.07,78.44 87.07,82.97 CN7.2
$3N20282: length 11.4
  Top Layer w0.762: R30.2 73.87,76.94 76.71,79.78 CN9.2
$3N20291: length 7.5
  Top Layer w0.762: R34.2 111.04,80.32 108.19,83.17
$3N20301: length 7.3
  Top Layer w0.762: CN13.2 69.67,6.01 R48.2
$3N20311: length 6.6
  Top Layer w0.762: CN12.2 82.29,9.81 R46.2
$3N20318: length 7.2
  Top Layer w0.762: CN10.2 92.84,8.25 R44.2
$3N20331: length 10.4
  Top Layer w0.762: R50.2 108.33,10.24 105.45,10.24 103.26,8.05 CN11.2
$4N2340: length 12.8
  Top Layer w0.254: U37.1 64.8,18.07 65.07,18.34 65.07,24.17 64.12,25.12 62.38,25.12 61.96,25.54 R64.2
$4N2422: length 38
  Top Layer w0.254: U38.1 56.75,15.21 56.73,15.19 v1(56.64,15.19) ; R67.1 39.59,23.09 v1(39.81,22.87)
  Bottom Layer w0.254: v1(39.81,22.87) 39.81,27.87 41.27,29.33 45.81,29.33 46.9,28.24 46.9,23.79 50.01,20.68 53.62,20.68 56.64,17.66 v1(56.64,15.19)
$4N4574: length 22.4
  Top Layer w0.381: v1(44.19,15.61) 44.19,14.37 R60.1 ; v1(44.23,19.6) 44.23,19.59 42.2,19.59
  Top Layer w0.762: CN14.2 41.91,11.22 D4.1 42.14,13.18 43.32,14.37 R60.1 44.1,14.46 R61.2
  Bottom Layer w0.381: v1(44.23,19.6) 44.22,19.61 44.22,15.64 v1(44.19,15.61)
$4N4575: length 22.3
  Top Layer w0.381: R59.1 46,14.42 45.87,14.55 ; 45.87,14.55 45.87,18.06 45.61,18.32 42.2,18.32 ; 45.87,14.55 R60.2
  Top Layer w0.762: R60.2 45.73,14.33 46.32,14.33 47.32,13.33 D4.2 47.32,4.35 CN14.1
$4N5104: length 6.5
  Top Layer w0.254: U35.1 58.41,24.97 59.41,23.97 R62.2

## Copper pours and planes (outline as drawn; the poured copper is in the pictures)
3.3V on Top Layer: 39.31,31.26 42.69,31.26 42.69,32.72 39.31,32.72
3.3V on Top Layer: 42.16,31.27 44.76,31.27 44.76,33.8 42.16,33.8
GND on Top Layer: -1.37,9.18 10.7,9.18 10.91,8.97 10.91,2.68 10.98,2.61 16.16,2.61 16.16,9.03 16.12,9.07 37.95,9.07 37.99,9.03 37.99,13.27 49.15,13.27 49.22,13.2 49.22,9 66.21,9 66.36,10.97 67.21,29.66 69.34,28.85 123.15,28.85 124.01,29.71 124.01,57.22 123.05,58.18 106.95,58.18 106.19,57.42 -1.42,57.42 -1.51,57.33 -1.51,9.31 -1.37,9.17
GND on Bottom Layer: 36.69,20.29 36.69,17.61 37.27,17.03 41.1,17.03 41.15,17.08 41.15,18.92 41.41,19.18 41.41,20 40.93,20.48 36.87,20.48 36.68,20.29
GND on Bottom Layer: -0.53,57.12 122.36,57.12 122.71,56.77 122.71,28.53 122.64,28.46 67.47,28.46 67.27,28.66 67.27,9.65 66.52,8.9 54.31,8.9 53.89,8.48 53.89,13.62 53.8,13.71 39.4,13.71 38.47,12.78 38.47,9.16 38.23,8.92 37.99,9.16 16.69,9.16 16.54,9.01 16.54,2.69 16.4,2.55 10.94,2.55 10.94,8.88 10.8,9.01 -0.8,9.01 -1,9.21 -1,56.65
SDA2 on Top Layer: 86.33,45.78 88.58,45.78 88.58,44.66 86.33,44.66

Small or netless copper shapes (teardrops, artwork), in the pictures only: 782 on Top Layer, 131 on Bottom Layer

## Text on the board
Top Silkscreen Layer: 3.3V | DI | SW | GND
